# EasyEDA Pro project Dart25-有控镖航电系统.eprj, schematic Schematic7
Create Date: 2024-11-16; Page Name: P1; Project Name: Dart25-有控镖航电系统; Schematic Name: Schematic7; Update Date: 2024-11-16; Company: 嘉立创EDA; Page Size: A4; Version: V1.0
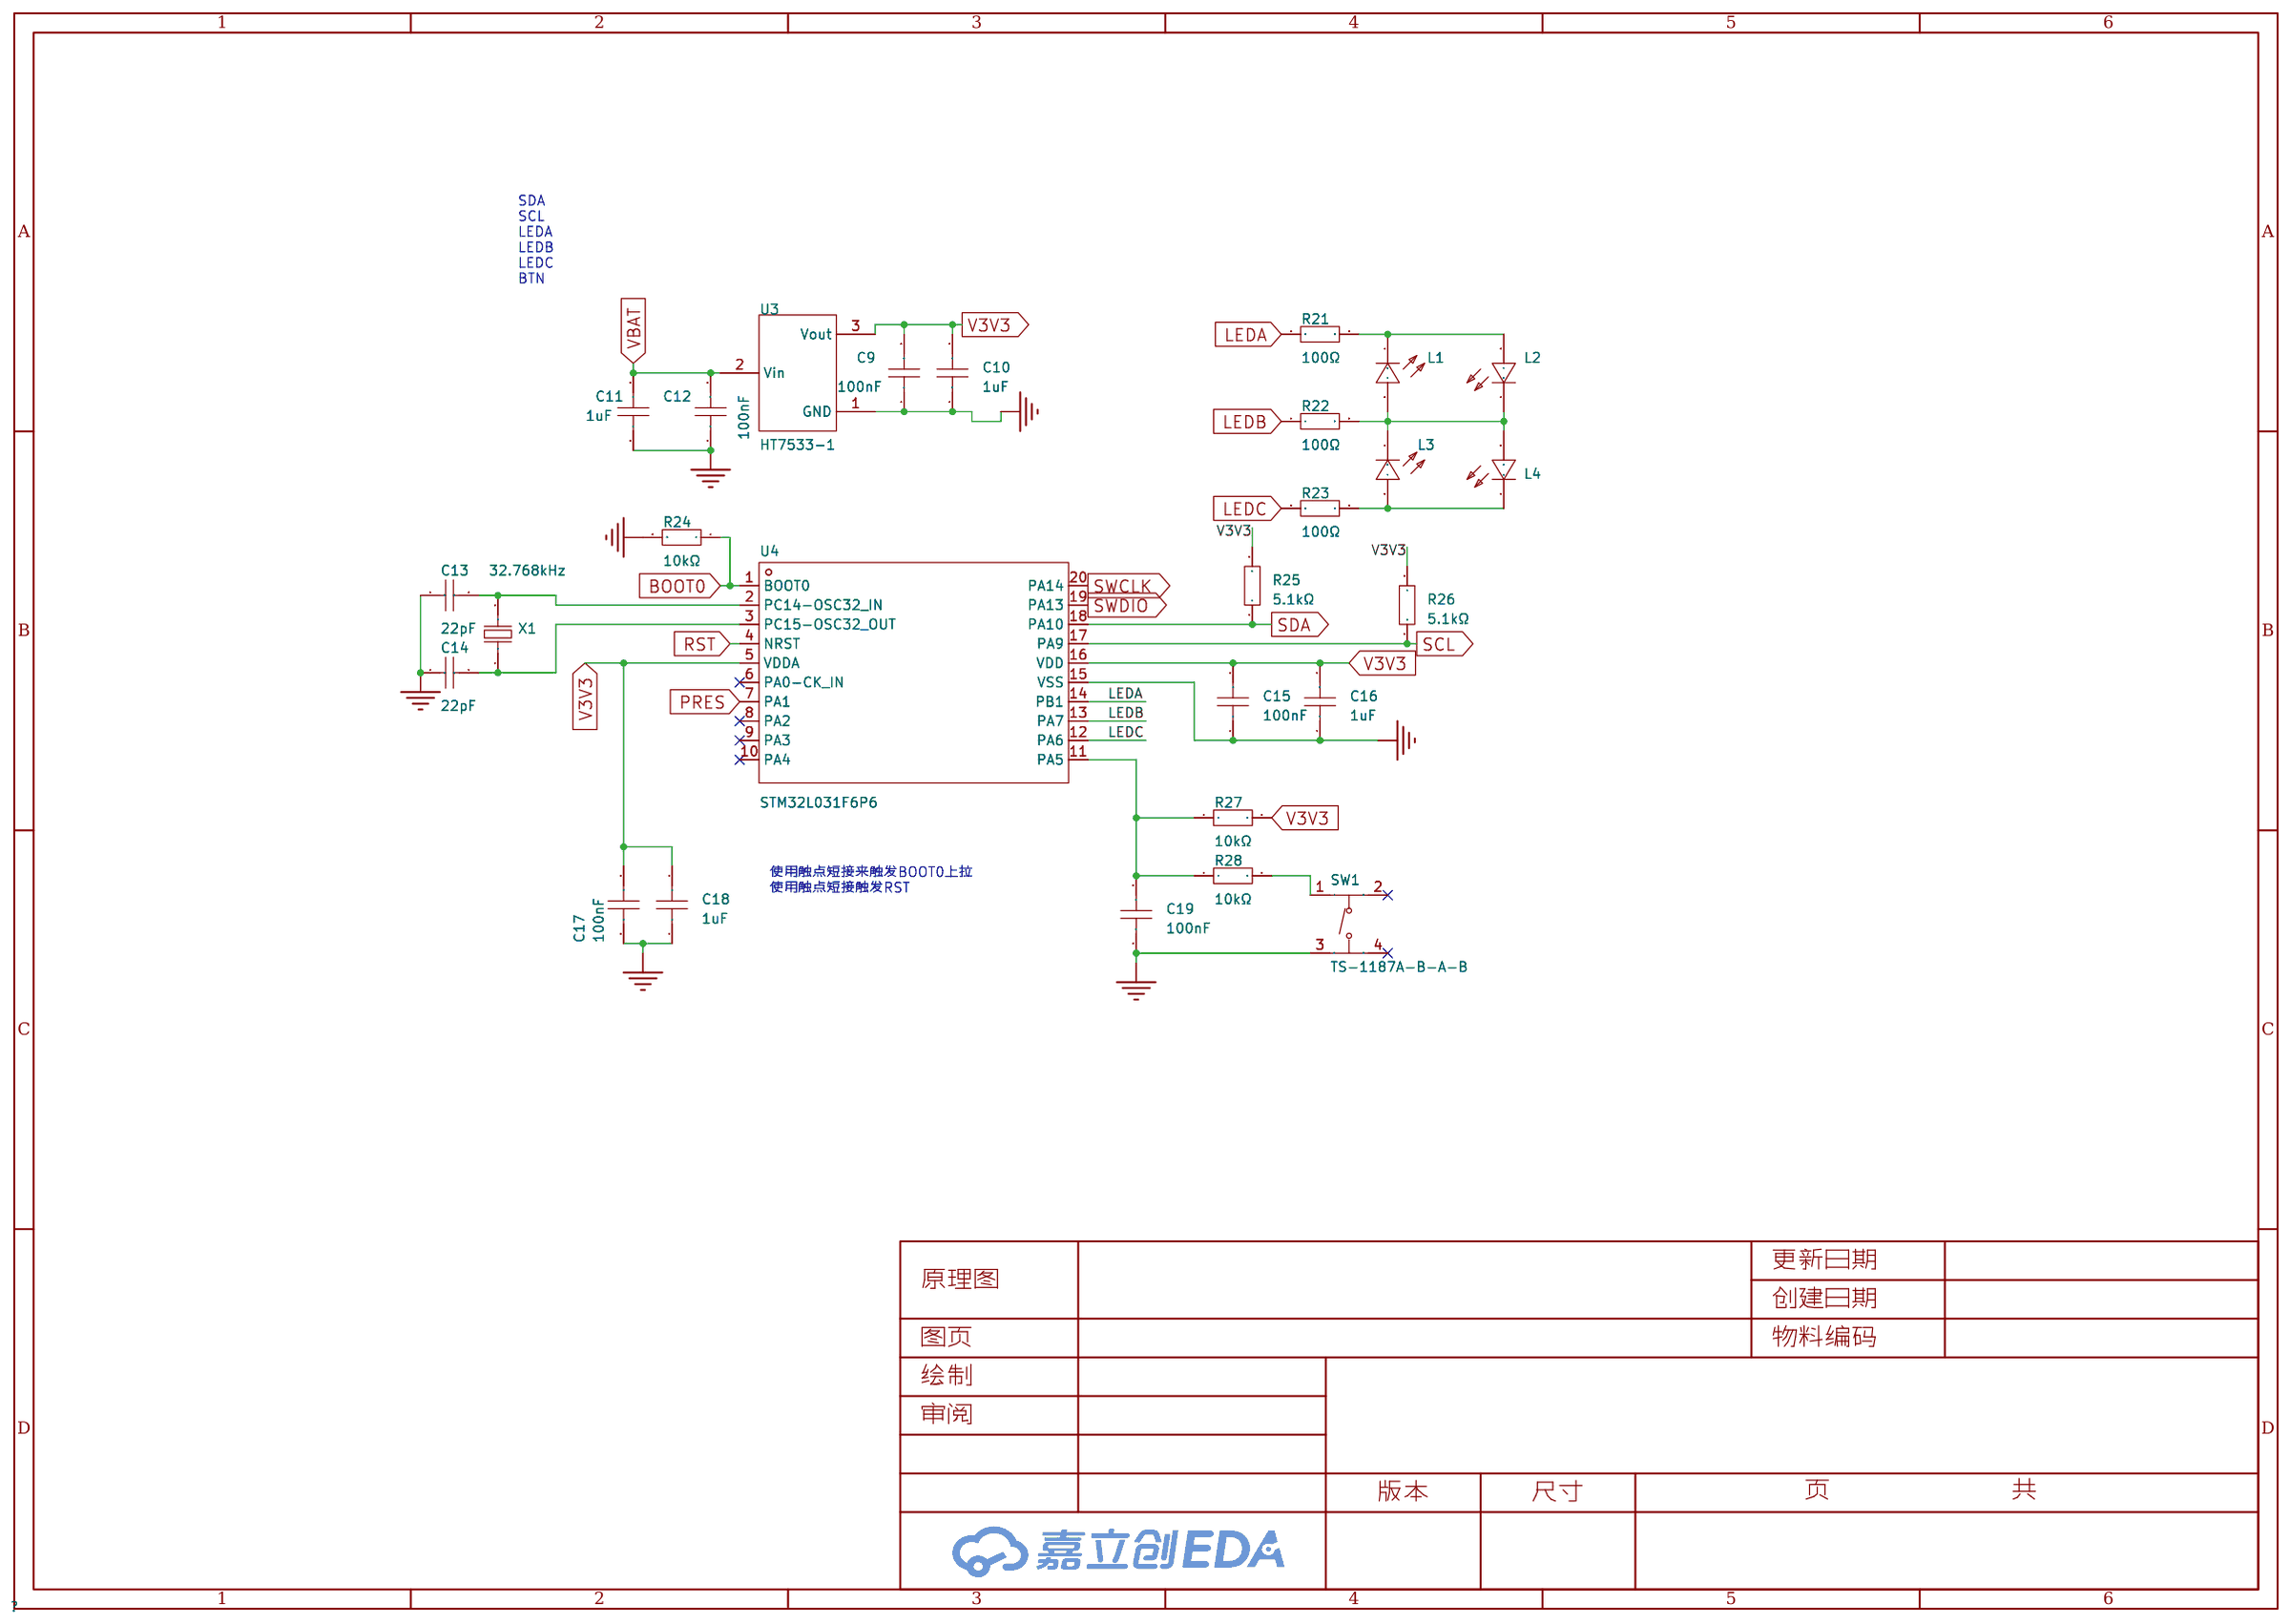
[diagram p5: schematic sheet]

## Parts
C9  100nF  [C0402]
C10  1uF  [C0402]
C11  1uF  [C0402]
C12  100nF  [C0402]
C13  22pF  [C0402]
C14  22pF  [C0402]
C15  100nF  [C0402]
C16  1uF  [C0402]
C17  100nF  [C0402]
C18  1uF  [C0402]
C19  100nF  [C0402]
L1  19-213/Y2C-CQ2R2L/3T(CY)  [LED0603-RD-YELLOW]
L2  19-213/Y2C-CQ2R2L/3T(CY)  [LED0603-RD-YELLOW]
L3  19-213/Y2C-CQ2R2L/3T(CY)  [LED0603-RD-YELLOW]
L4  19-213/Y2C-CQ2R2L/3T(CY)  [LED0603-RD-YELLOW]
R21  100Ω  [R0402]
R22  100Ω  [R0402]
R23  100Ω  [R0402]
R24  10kΩ  [R0402]
R25  5.1kΩ  [R0402]
R26  5.1kΩ  [R0402]
R27  10kΩ  [R0402]
R28  10kΩ  [R0402]
SW1  TS-1187A-B-A-B  [SW-SMD_4P-L5.1-W5.1-P3.70-LS6.5-TL-2]
U3  HT7533-1  [SOT-89-3_L4.5-W2.5-P1.50-LS4.2-BR]
U4  STM32L031F6P6  [TSSOP-20_L6.5-W4.4-P0.65-LS6.4-BL]
X1  32.768kHz  [fc-135r_l3.2-w1.5]

## Library data of the parts
C9 C12 C15 C17 C19 = CL05B104KO5NNNC: 容值:100nF;精度:±10%;额定电压:16V;材质(温度系数):X7R;; LCSC Part Name: 100nF ±10% 16V; Supplier Part: C1525; Manufacturer: SAMSUNG(三星); Supplier Footprint: 0402; JLCPCB Part Class: 基础库; Datasheet: https://atta.szlcsc.com/upload/public/pdf/source/20160218/1457707763339.pdf; Supplier: LCSC; Tolerance: ±10%; Voltage Rated: 16V; Temperature Coefficient: X7R
C10 C11 C16 C18 = CL05A105KA5NQNC: 容值:1uF;精度:±10%;额定电压:25V;材质(温度系数):X5R;; LCSC Part Name: 1uF ±10% 25V; Supplier Part: C52923; Manufacturer: SAMSUNG(三星); Supplier Footprint: 0402; JLCPCB Part Class: 基础库; Datasheet: https://atta.szlcsc.com/upload/public/pdf/source/20160218/1457707763339.pdf; Supplier: LCSC; Tolerance: ±10%; Voltage Rated: 25V; Temperature Coefficient: X5R
C13 C14 = 0402CG220J500NT: 容值:22pF;精度:±5%;额定电压:50V;材质(温度系数):C0G;; LCSC Part Name: 22pF ±5% 50V; Supplier Part: C1555; Manufacturer: FH(风华); Supplier Footprint: 0402; JLCPCB Part Class: 基础库; Datasheet: https://atta.szlcsc.com/upload/public/pdf/source/20200305/C486355_26A10D38EF8C2A5C37091D0039909270.pdf; Supplier: LCSC; Tolerance: ±5%; Voltage Rated: 50V; Temperature Coefficient: C0G
L1-L4 = 19-213/Y2C-CQ2R2L/3T(CY): 发光颜色:黄色;功率:60mW;正向电流:20mA;主波长:585.5nm~591.5nm;二极管配置:-;透镜颜色:无色透明透镜;色温:-;发光角度:120°;载带方式:-;工作温度:-40℃~+85℃;; LCSC Part Name: 黄灯; Supplier Part: C72038; Manufacturer: EVERLIGHT(亿光); Supplier Footprint: 0603; JLCPCB Part Class: 基础库; Datasheet: https://atta.szlcsc.com/upload/public/pdf/source/20160507/1462613613586.pdf; Supplier: LCSC; Emitted Color: 黄色; Power Dissipation: 60mW; Forward Current: 20mA; Dominant Wavelength: 585.5nm~591.5nm; Peak Wavelength: 591nm; Lens Color: 无色透明透镜; Viewing Angle: 120°; Operating Temperature: -40℃~+85℃
R21-R23 = 0402WGF1000TCE: 电阻类型:厚膜电阻;阻值:100Ω;精度:±1%;功率:62.5mW;最大工作电压:50V;温度系数:±200ppm/℃;; LCSC Part Name: 100Ω ±1% 62.5mW 厚膜电阻; Supplier Part: C25076; Manufacturer: UNI-ROYAL(厚声); Supplier Footprint: 0402; JLCPCB Part Class: 基础库; Datasheet: https://atta.szlcsc.com/upload/public/pdf/source/20200306/C422600_1E6D84923E4A46A82E41ADD87F860B5C.pdf; Supplier: LCSC; Type: 厚膜电阻; Tolerance: ±1%; Power(Watts): 62.5mW; Overload Voltage (Max): 50V; Temperature Coefficient: ±200ppm/℃; Operating Temperature Range: -55℃~+155℃
R24 R27 R28 = 0402WGF1002TCE: 电阻类型:厚膜电阻;阻值:10kΩ;精度:±1%;功率:62.5mW;最大工作电压:50V;温度系数:±100ppm/℃;; LCSC Part Name: 10kΩ ±1% 62.5mW 厚膜电阻; Supplier Part: C25744; Manufacturer: UNI-ROYAL(厚声); Supplier Footprint: 0402; JLCPCB Part Class: 基础库; Datasheet: https://atta.szlcsc.com/upload/public/pdf/source/20200306/C422600_1E6D84923E4A46A82E41ADD87F860B5C.pdf; Supplier: LCSC; Type: 厚膜电阻; Tolerance: ±1%; Power(Watts): 62.5mW; Overload Voltage (Max): 50V; Temperature Coefficient: ±100ppm/℃; Operating Temperature Range: -55℃~+155℃
R25 R26 = 0402WGF5101TCE: 电阻类型:厚膜电阻;阻值:5.1kΩ;精度:±1%;功率:62.5mW;最大工作电压:50V;温度系数:±100ppm/℃;; LCSC Part Name: 5.1kΩ ±1% 62.5mW 厚膜电阻; Supplier Part: C25905; Manufacturer: UNI-ROYAL(厚声); Supplier Footprint: 0402; JLCPCB Part Class: 基础库; Datasheet: https://atta.szlcsc.com/upload/public/pdf/source/20200306/C422600_1E6D84923E4A46A82E41ADD87F860B5C.pdf; Supplier: LCSC; Type: 厚膜电阻; Tolerance: ±1%; Power(Watts): 62.5mW; Overload Voltage (Max): 50V; Temperature Coefficient: ±100ppm/℃; Operating Temperature Range: -55℃~+155℃
SW1 = TS-1187A-B-A-B: 电路结构:单刀单掷;按钮形状:圆形按钮;作用力:160gf;安装方式:立贴;开关长度:5.1mm;开关宽度:5.1mm;开关高度:1.5mm;带支架:不带;触点电流:50mA;额定电压(DC):12V;绝缘电阻:-;带灯:无;机械寿命:10万次;; LCSC Part Name: 5.1*5.1*1.5mm 立贴 轻触开关; Supplier Part: C318884; Manufacturer: XKB Connectivity(中国星坤); Supplier Footprint: SMD; JLCPCB Part Class: 基础库; Datasheet: https://atta.szlcsc.com/upload/public/pdf/source/20200227/C318890_053E50208A88A7BA1965D8746000774E.pdf; Supplier: LCSC; Circuit: 单刀单掷; Actuator Style: 圆形按钮; Operating Force: 160gf; Mounting Style: 立贴; Switch Length: 5.1mm; Switch Width: 5.1mm; Switch Height: 1.5mm; Strike Gundam: 不带; Contact Current: 50mA; Voltage Rating (DC): 12V; Actuator/Cap Color: 金色; With Lamp: 无; Mechanical Life: 10万次; Operating Temperature: -30℃~+85℃
U3 = HT7533-1_C14289: 输出类型:固定;最大输入电压:30V;输出电压:3.3V;最大输出电流:100mA;电源纹波抑制比(PSRR):-;输出极性:正极;; LCSC Part Name: 输入30V 输出3.3V 100mA; Supplier Part: C14289; Manufacturer: HOLTEK(合泰/盛群); Supplier Footprint: SOT-89-3; JLCPCB Part Class: 基础库; Datasheet: https://atta.szlcsc.com/upload/public/pdf/source/20231219/BDECE6E78805324723A3C89E22CB6270.pdf; Supplier: LCSC; Output Type: 固定; Maximum Input Voltage: 30V; Output Voltage: 3.3V; MAX Output Current: 100mA; Dropout Voltage: 55mV@(1mA); Output Polarity: 正极; Number of Outputs: 1
U4 = STM32L031F6P6: CPU内核:-;程序存储容量:32KB;RAM总容量:8KB;GPIO端口数量:15;工作电压范围:1.8V~3.6V;CPU最大主频:32MHz;程序存储器类型:FLASH;; LCSC Part Name: 超低功耗Arm Cortex-M0+ MCU，具有32-KB Flash存储器和32 MHz CPU; Supplier Part: C115208; Manufacturer: ST(意法半导体); Supplier Footprint: TSSOP-20; JLCPCB Part Class: 扩展库; Datasheet: https://atta.szlcsc.com/upload/public/pdf/source/20170818/C115208_1503051154466895131.pdf; Supplier: LCSC; Program Storage Size: 32KB; RAM Size: 8KB; GPIO Ports Number: 15; Operating Voltage Range: 1.8V~3.6V; CPU Maximum Speed: 32MHz; Program Memory Type: FLASH; Operating Temperature Range: -40℃~+85℃; ADC (Bit): 12bit; Peripheral/Function: DMA；PWM; Watchdog: 有; Infrared Data Association: 有; Low-Voltage Detect: 有; Direct Memory Access: 有; Internal Oscillator: 有
X1 = Q13FC13500004_C32346: 晶振类型:贴片晶振;频率:32.768kHz;常温频差:±20ppm;外接负载电容:12.5pF;; LCSC Part Name: 32.768kHz ±20ppm 12.5pF; Supplier Part: C32346; Manufacturer: EPSON(爱普生); Manufacturer Part: Q13FC13500004; Supplier Footprint: SMD3215-2P; JLCPCB Part Class: 基础库; Datasheet: https://atta.szlcsc.com/upload/public/pdf/source/20240418/0E0FF5F0356BA3753F616001439D1416.pdf; Supplier: LCSC; Crystal Type: 贴片晶振; Normal temperature Frequency Tolerance: ±20ppm; External load capacitor: 12.5pF; Equivalent Series Resistance (ESR): 70kΩ; Operating Temperature: -40℃~+85℃

## Nets
GND: C9.1 C10.1 C11.1 C12.1 C13.1 C14.1 C15.1 C16.1 C17.1 C18.1 C19.1 R24.2 SW1.3(C) U3.1(GND) U4.15(VSS)
V3V3: C9.2 C10.2 C15.2 C16.2 C17.2 C18.2 R25.2 R26.2 R27.2 U3.3(Vout) U4.5(VDDA) U4.16(VDD)
VBAT: C11.2 C12.2 U3.2(Vin)
BOOT0: R24.1 U4.1(BOOT0)
LEDA: R21.1 U4.14(PB1)
LEDB: R22.1 U4.13(PA7)
LEDC: R23.1 U4.12(PA6)
PRES: U4.7(PA1)
RST: U4.4(NRST)
SCL: R26.1 U4.17(PA9)
SDA: R25.1 U4.18(PA10)
SWCLK: U4.20(PA14)
SWDIO: U4.19(PA13)
Net-(C13-2): C13.2 U4.2(PC14-OSC32_IN) X1.2
Net-(C14-2): C14.2 U4.3(PC15-OSC32_OUT) X1.1
Net-(C19-2): C19.2 R27.1 R28.1 U4.11(PA5)
Net-(L1-1): L1.1(C) L2.2(A) R21.2
Net-(L1-2): L1.2(A) L2.1(C) L3.1(C) L4.2(A) R22.2
Net-(L3-2): L3.2(A) L4.1(C) R23.2
Net-(R28-2): R28.2 SW1.1(A)

Not connected (* = marked no-connect by the designer): SW1 2(B)* 4(D)*; U4 6(PA0-CK_IN)* 8(PA2)* 9(PA3)* 10(PA4)*

## Notes on the sheet
- SDA
  SCL
  LEDA
  LEDB
  LEDC
  BTN
- 使用触点短接来触发BOOT0上拉
  使用触点短接触发RST
